# EAGLE schematic Dragino Pan.v1.7 (EAGLE 7.5.0)

## Sheet 1 of 6
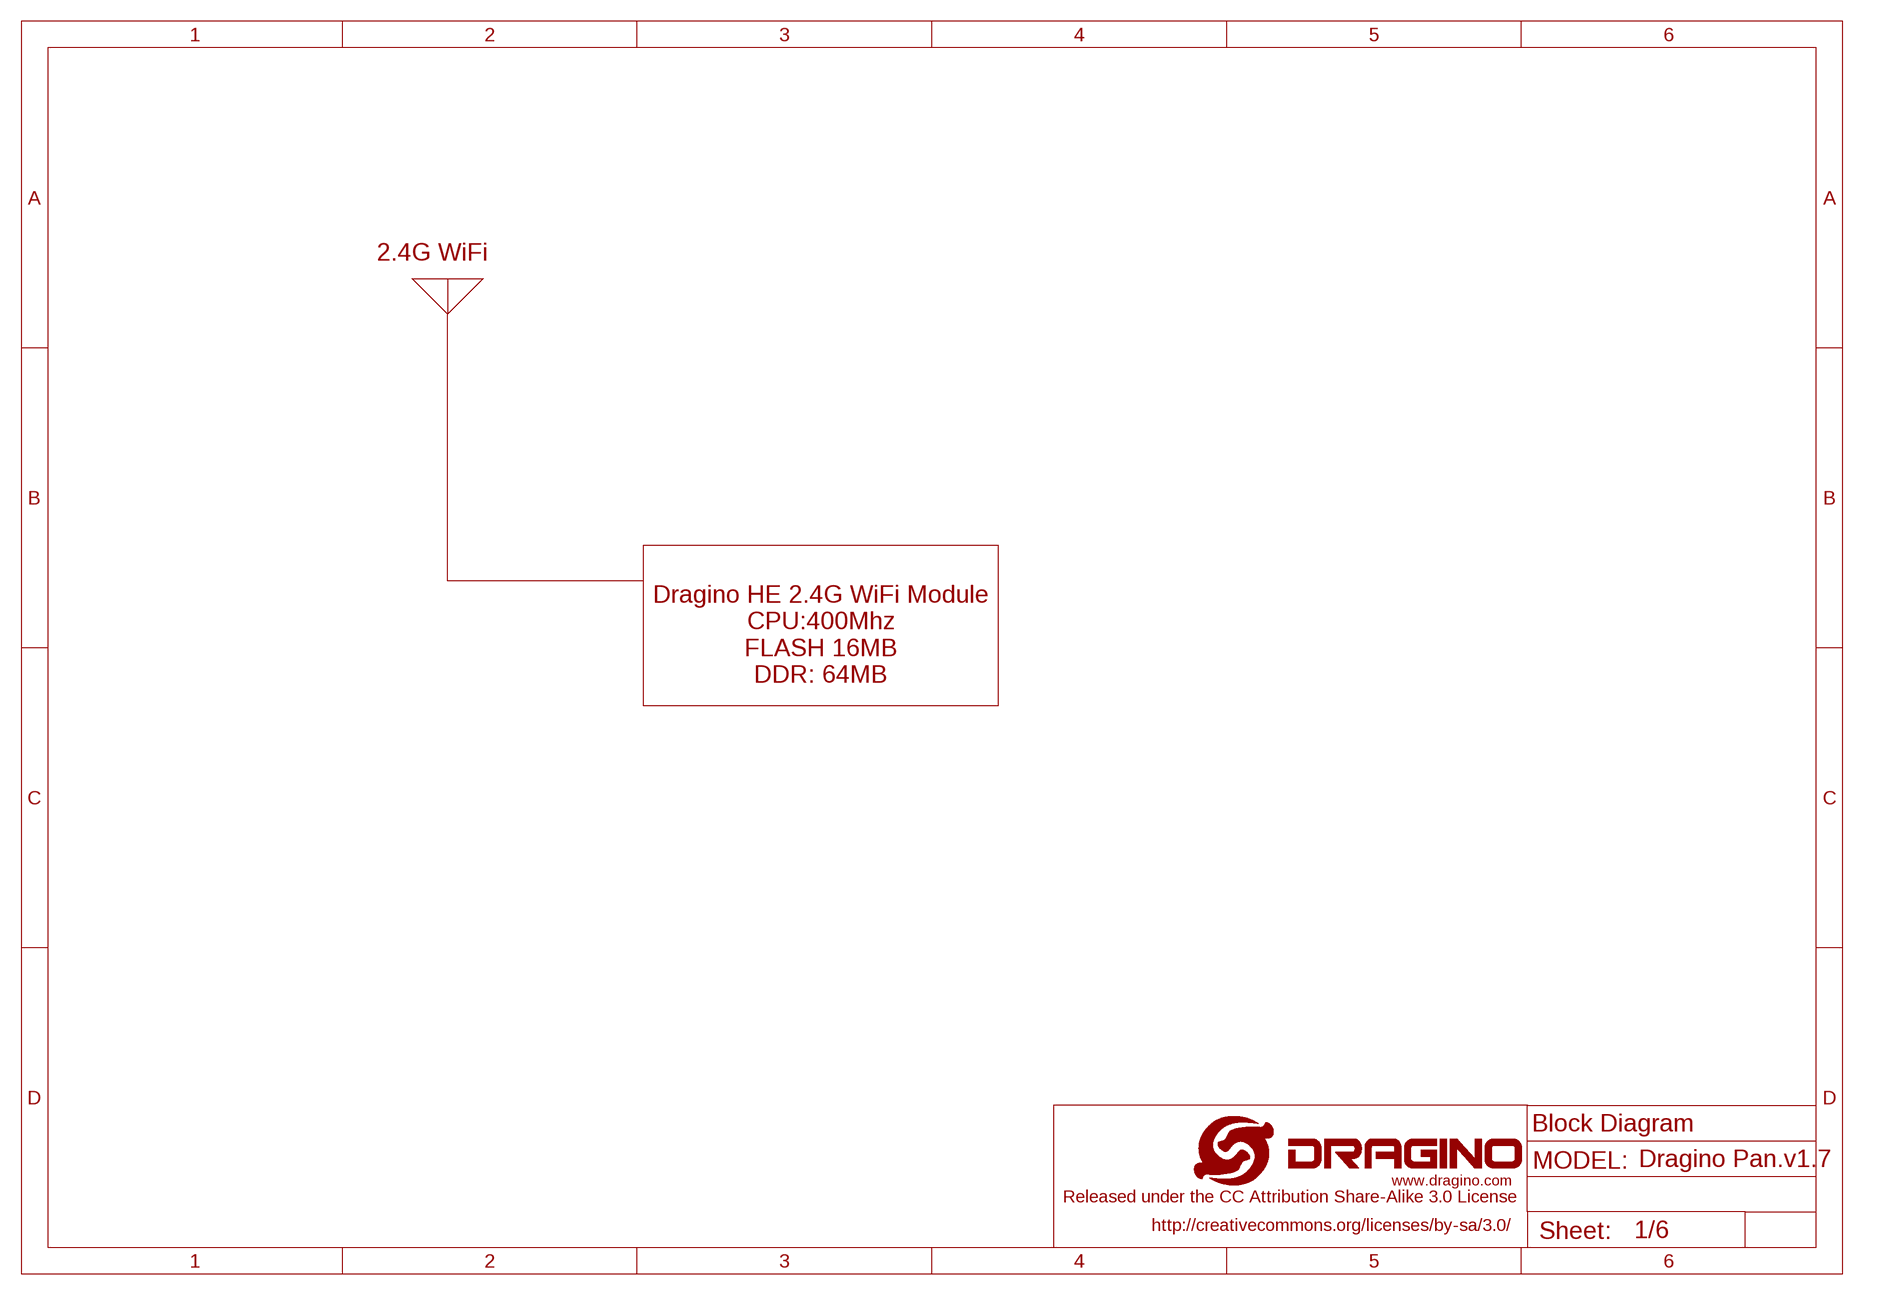
[diagram p0: schematic, sheet 1]

### Notes on the sheet
- 2.4G WiFi
- Dragino HE 2.4G WiFi Module
  CPU:400Mhz
  FLASH 16MB
  DDR: 64MB
- Block Diagram

## Sheet 2 of 6
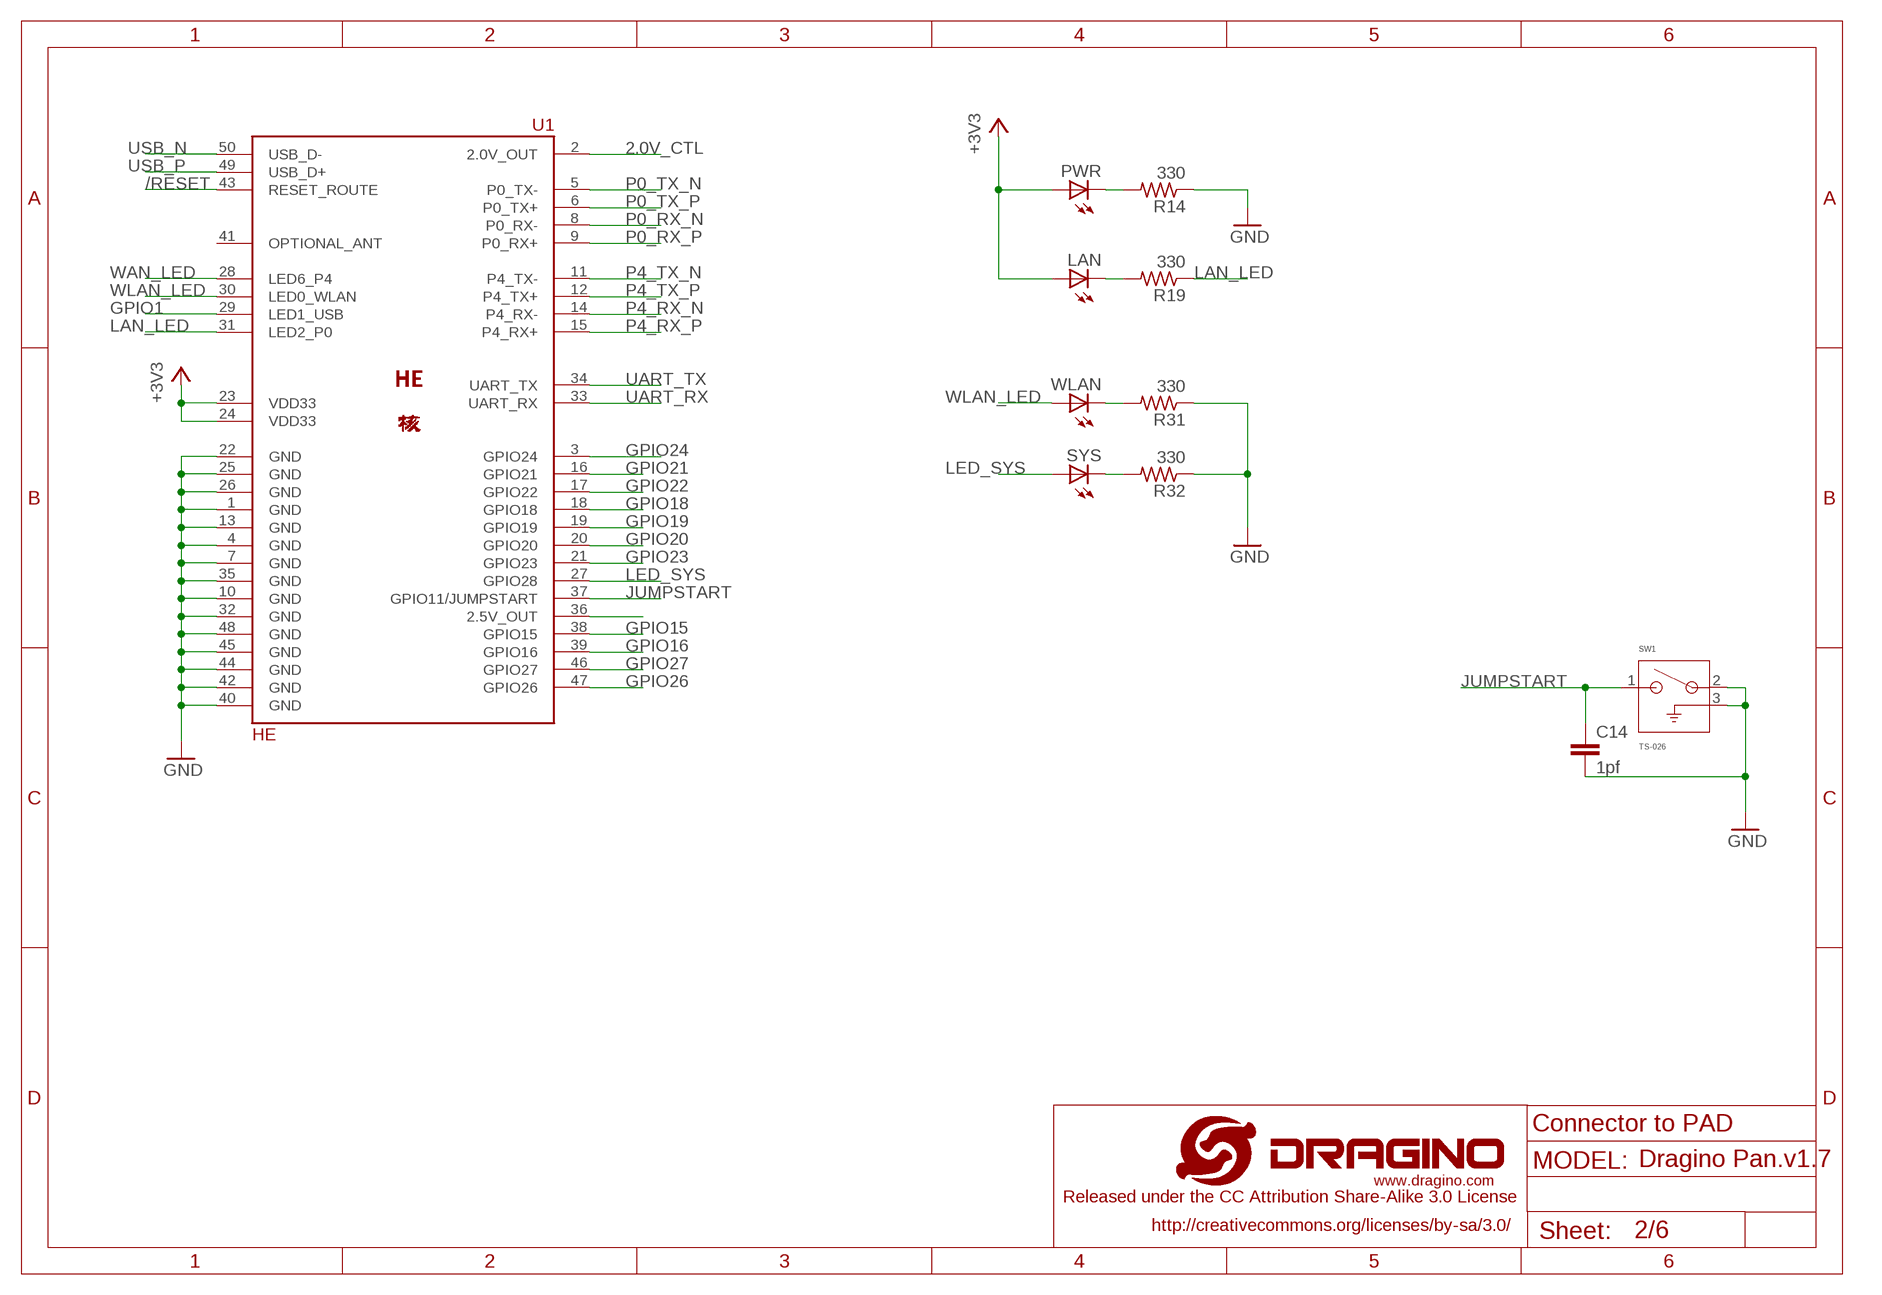
[diagram p1: schematic, sheet 2]

### Parts
C14  1pf  C-EUC0402  [C0402]
LAN  LED3MM  [LED3MM]
PWR  LED3MM  [LED3MM]
R14  330  R-US_R0402  [R0402]
R19  330  R-US_R0402  [R0402]
R31  330  R-US_R0402  [R0402]
R32  330  R-US_R0402  [R0402]
SW1  TS-026  [TS-026]
SYS  LED3MM  [LED3MM]
U1  HE  [HE50]
U$3  LOGO-NEW  [LOGO-SILK-NEW]
WLAN  LED3MM  [LED3MM]

### Nets
2.0V_CTL: U1.2(2.0V_OUT) ; also sheet 4
+3V3: LAN.A PWR.A U1.23(VDD33) U1.24(VDD33) ; also sheet 3,5
/RESET: U1.43(RESET_ROUTE) ; also sheet 5
GND: C14.2 R14.1 R31.1 R32.1 SW1.2 SW1.3 U1.1(GND) U1.4(GND) U1.7(GND) U1.10(GND) U1.13(GND) U1.22(GND) U1.25(GND) U1.26(GND) U1.32(GND) U1.35(GND) U1.40(GND) U1.42(GND) U1.44(GND) U1.45(GND) U1.48(GND) ; also sheet 3,4,5,6
GPIO1: U1.29(LED1_USB) ; also sheet 3
GPIO15: U1.38(GPIO15) ; also sheet 5
GPIO16: U1.39(GPIO16) ; also sheet 5
GPIO18: U1.18(GPIO18) ; also sheet 5
GPIO19: U1.19(GPIO19) ; also sheet 5
GPIO20: U1.20(GPIO20) ; also sheet 5
GPIO21: U1.16(GPIO21) ; also sheet 5
GPIO22: U1.17(GPIO22) ; also sheet 5
GPIO23: U1.21(GPIO23) ; also sheet 5
GPIO24: U1.3(GPIO24) ; also sheet 5
GPIO26: U1.47(GPIO26) ; also sheet 5
GPIO27: U1.46(GPIO27) ; also sheet 5
JUMPSTART: C14.1 SW1.1 U1.37(GPIO11/JUMPSTART)
LAN_LED: R19.1 U1.31(LED2_P0)
LED_SYS: SYS.A U1.27(GPIO28)
N$6: PWR.K(C) R14.2
N$23: LAN.K(C) R19.2
N$31: R31.2 WLAN.K(C)
N$32: R32.2 SYS.K(C)
N$52: U1.36(2.5V_OUT)
P0_RX_N: U1.8(P0_RX-) ; also sheet 4
P0_RX_P: U1.9(P0_RX+) ; also sheet 4
P0_TX_N: U1.5(P0_TX-) ; also sheet 4
P0_TX_P: U1.6(P0_TX+) ; also sheet 4
P4_RX_N: U1.14(P4_RX-) ; also sheet 4
P4_RX_P: U1.15(P4_RX+) ; also sheet 4
P4_TX_N: U1.11(P4_TX-) ; also sheet 4
P4_TX_P: U1.12(P4_TX+) ; also sheet 4
UART_RX: U1.33(UART_RX) ; also sheet 5
UART_TX: U1.34(UART_TX) ; also sheet 5
USB_N: U1.50(USB_D-) ; also sheet 6
USB_P: U1.49(USB_D+) ; also sheet 6
WAN_LED: U1.28(LED6_P4)
WLAN_LED: U1.30(LED0_WLAN) WLAN.A

### Notes on the sheet
- Connector to PAD

## Sheet 3 of 6
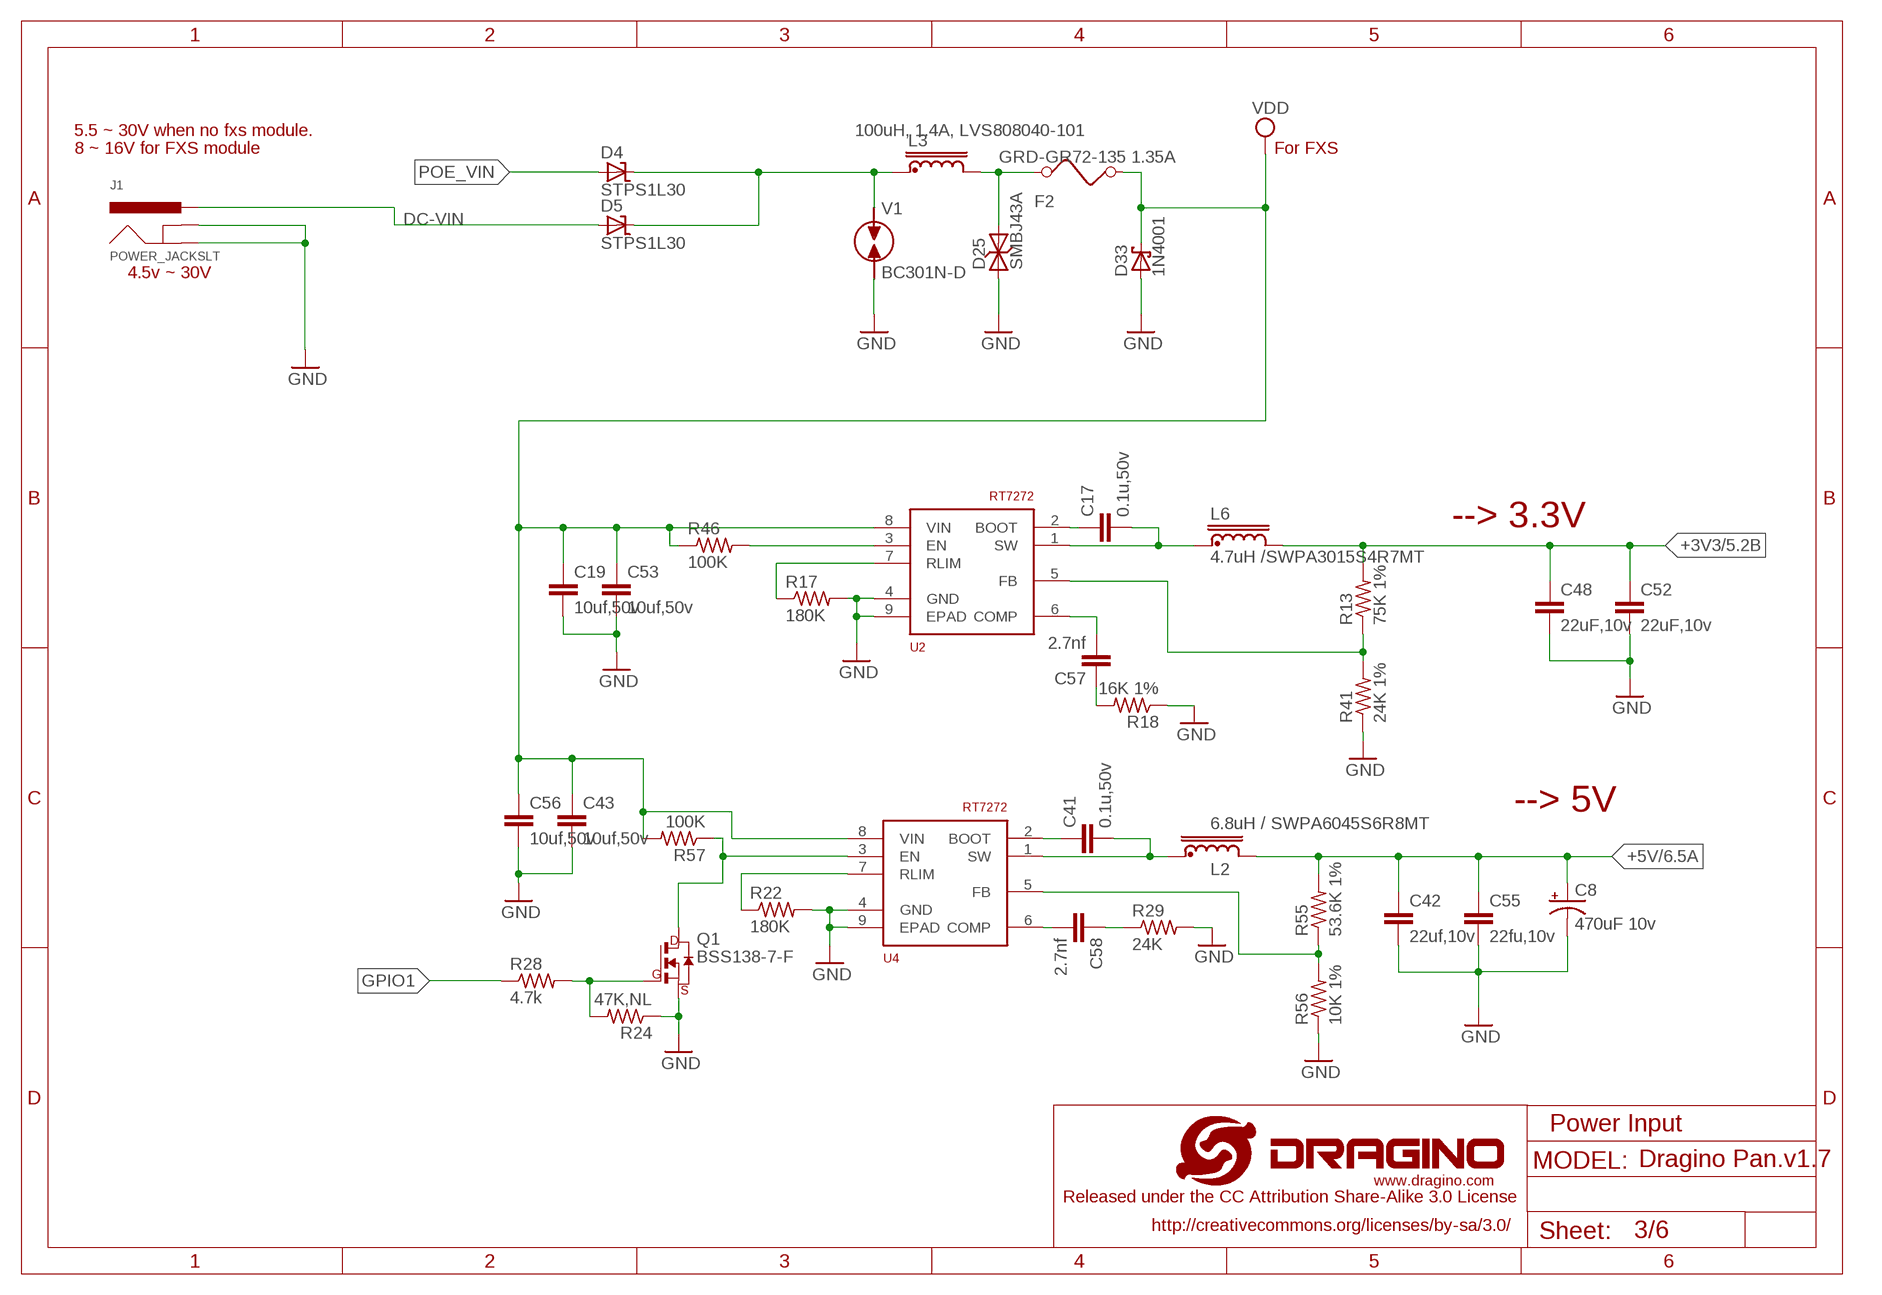
[diagram p2: schematic, sheet 3]

### Parts
C8  470uF 10v  CPOL-US140CLH-0810  [140CLH-0810]
C17  0.1u,50v  C-EUC0402  [C0402]
C19  10uf,50v  C-EUC1206  [C1206]
C41  0.1u,50v  C-EUC0402  [C0402]
C42  22uf,10v  C-EUC1210  [C1210]
C43  10uf,50v  C-EUC1206  [C1206]
C48  22uF,10v  C-EUC1210  [C1210]
C52  22uF,10v  C-EUC1210  [C1210]
C53  10uf,50v  C-EUC1206  [C1206]
C55  22fu,10v  C-EUC1210  [C1210]
C56  10uf,50v  C-EUC1206  [C1206]
C57  2.7nf  C-EUC0402  [C0402]
C58  2.7nf  C-EUC0402  [C0402]
D4  STPS1L30  SCHOTTKYSMBG  [DO214AC]
D5  STPS1L30  SCHOTTKYSMBG  [DO214AC]
D25  SMBJ43A  TVSDIO-214AA  [DO-214AA]
D33  1N4001  SCHOTTKY-DIODEF126Z12  [F126Z12]
F2  GRD-GR72-135 1.35A  FUSEGR72-135  [GR72-135]
J1  POWER_JACKSLT  [POWER_JACK_SLOT]
L2  6.8uH / SWPA6045S6R8MT  INDUCTOR6028S  [SWPA6028S]
L3  100uH, 1.4A, LVS808040-101  INDUCTORLVS808040  [LVS808040]
L6  4.7uH /SWPA3015S4R7MT  INDUCTORSWPA3010S  [SWPA3010S]
Q1  BSS138-7-F  NMOSFET  [SOT-23]
R13  75K 1%  R-US_R0402  [R0402]
R17  180K  R-US_R0402  [R0402]
R18  16K 1%  R-US_R0402  [R0402]
R22  180K  R-US_R0402  [R0402]
R24  47K,NL  R-US_R0402  [R0402]
R28  4.7k  R-US_R0402  [R0402]
R29  24K  R-US_R0402  [R0402]
R41  24K 1%  R-US_R0402  [R0402]
R46  100K  R-US_R0402  [R0402]
R55  53.6K 1%  R-US_R0402  [R0402]
R56  10K 1%  R-US_R0402  [R0402]
R57  100K  R-US_R0402  [R0402]
U2  RT7272  [RT8250-SOP8]
U4  RT7272  [RT8250-SOP8]
V1  BC301N-D  GDT-2PIN  [BC301N-D]

### Nets
+3V3: C48.1 C52.1 L6.P$2 R13.2 ; also sheet 2,5
+5V: C8.+ C42.1 C55.1 L2.P$2 R55.2 ; also sheet 5,6
DC-VIN: D5.A J1.PWR
GND: C8.- C19.2 C42.2 C43.2 C48.2 C52.2 C53.2 C55.2 C56.2 D25.A D33.A J1.GND@1(GNDBREAK) J1.GND@2(GND) Q1.2(S) R17.2 R18.1 R22.2 R24.1 R29.2 R41.1 R56.1 U2.4(GND) U2.9(EPAD) U4.4(GND) U4.9(EPAD) V1.P$1 ; also sheet 2,4,5,6
GPIO1: R28.1 ; also sheet 2
N$2: C17.2 L6.P$1 U2.1(SW)
N$9: C57.1 R18.2
N$13: C57.2 U2.6(COMP)
N$14 [gnd]: R55.1 R56.2 U4.5(FB)
N$15: Q1.1(D) R57.1 U4.3(EN)
N$19: R22.1 U4.7(RLIM)
N$20: Q1.3(G) R24.2 R28.2
N$21: C58.2 U4.6(COMP)
N$25: R46.2 U2.3(EN)
N$26: R17.1 U2.7(RLIM)
N$27: C17.1 U2.2(BOOT)
N$28: C58.1 R29.1
N$34: C41.2 L2.P$1 U4.1(SW)
N$49: R13.1 R41.2 U2.5(FB)
N$53: D25.C F2.P$1 L3.P$2
N$55: C41.1 U4.2(BOOT)
POE_VIN: D4.A ; also sheet 4
VDD: C19.1 C43.1 C53.1 C56.1 D33.C F2.P$2 R46.1 R57.2 U2.8(VIN) U4.8(VIN) ; also sheet 5
VIN1: D4.C D5.C L3.P$1 V1.P$2

### Notes on the sheet
- 5.5 ~ 30V when no fxs module.
- 8 ~ 16V for FXS module | For FXS
- 4.5v ~ 30V
- --> 3.3V
- --> 5V
- Power Input

## Sheet 4 of 6
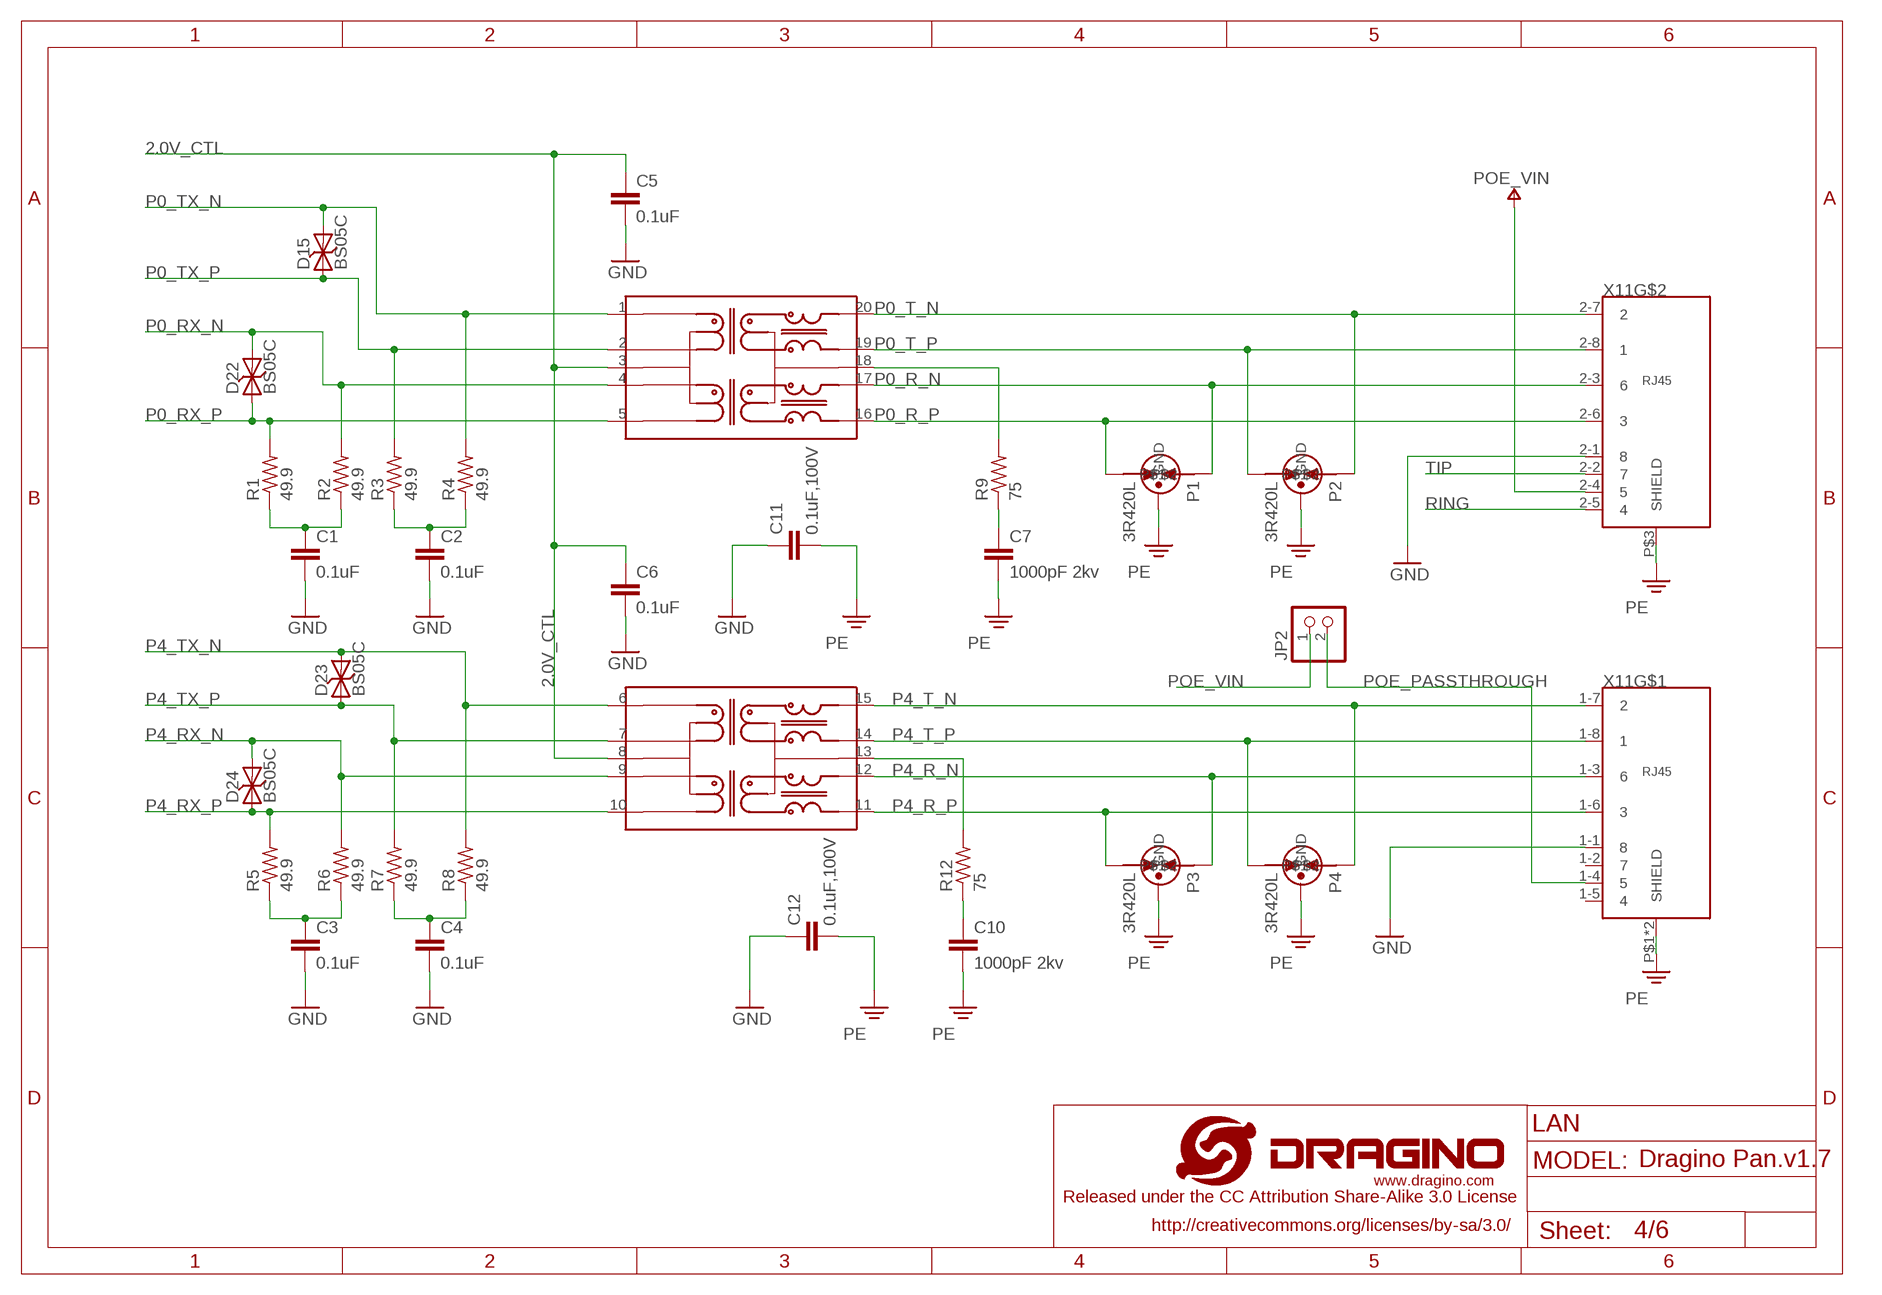
[diagram p3: schematic, sheet 4]

### Parts
C1  0.1uF  C-EUC0402  [C0402]
C2  0.1uF  C-EUC0402  [C0402]
C3  0.1uF  C-EUC0402  [C0402]
C4  0.1uF  C-EUC0402  [C0402]
C5  0.1uF  C-EUC0402  [C0402]
C6  0.1uF  C-EUC0402  [C0402]
C7  1000pF 2kv  C-EUC1206  [C1206]
C10  1000pF 2kv  C-EUC1206  [C1206]
C11  0.1uF,100V  C-EUC0805  [C0805]
C12  0.1uF,100V  C-EUC0805  [C0805]
D15  BS05C  TVSSOD323  [SOD−323]
D22  BS05C  TVSSOD323  [SOD−323]
D23  BS05C  TVSSOD323  [SOD−323]
D24  BS05C  TVSSOD323  [SOD−323]
JP2  PINHD-1X2  [1X02]
P1  3R420L  GDT  [GDT-LT-B3D090L]
P2  3R420L  GDT  [GDT-LT-B3D090L]
P3  3R420L  GDT  [GDT-LT-B3D090L]
P4  3R420L  GDT  [GDT-LT-B3D090L]
R1  49.9  R-US_R0402  [R0402]
R2  49.9  R-US_R0402  [R0402]
R3  49.9  R-US_R0402  [R0402]
R4  49.9  R-US_R0402  [R0402]
R5  49.9  R-US_R0402  [R0402]
R6  49.9  R-US_R0402  [R0402]
R7  49.9  R-US_R0402  [R0402]
R8  49.9  R-US_R0402  [R0402]
R9  75  R-US_R0402  [R0402]
R12  75  R-US_R0402  [R0402]
T1  RJ45_TRANSFORMER_HST2038DR  [RIONET_H2038]
X11  EHERNET-1X2-PLASTIC  [EHERNET-1X2-PLASTIC1]

### Nets
2.0V_CTL: C5.1 C6.1 T1.3(CT1) T1.8(CT1) ; also sheet 2
GND: C1.2 C2.2 C3.2 C4.2 C5.2 C6.2 C11.1 C12.1 X11.1-1 X11.2-1 ; also sheet 2,3,5,6
N$1: C1.1 R1.1 R2.1
N$3: C2.1 R3.1 R4.1
N$4: C3.1 R5.1 R6.1
N$5: C4.1 R7.1 R8.1
N$10: R9.2 T1.18(CT2)
N$12: C7.1 R9.1
N$17: R12.2 T1.13(CT2)
N$18: C10.1 R12.1
P0_R_N: P1.3 T1.17(RX+) X11.2-3
P0_R_P: P1.1 T1.16(RX-) X11.2-6
P0_RX_N: D22.P$2 R2.2 T1.4(RD+) ; also sheet 2
P0_RX_P: D22.P$1 R1.2 T1.5(RD-) ; also sheet 2
P0_T_N: P2.3 T1.20(TX+) X11.2-7
P0_T_P: P2.1 T1.19(TX-) X11.2-8
P0_TX_N: D15.P$2 R4.2 T1.1(TD+) ; also sheet 2
P0_TX_P: D15.P$1 R3.2 T1.2(TD-) ; also sheet 2
P4_R_N: P3.3 T1.12(RX+) X11.1-3
P4_R_P: P3.1 T1.11(RX-) X11.1-6
P4_RX_N: D24.P$2 R6.2 T1.9(RD+) ; also sheet 2
P4_RX_P: D24.P$1 R5.2 T1.10(RD-) ; also sheet 2
P4_T_N: P4.3 T1.15(TX+) X11.1-7
P4_T_P: P4.1 T1.14(TX-) X11.1-8
P4_TX_N: D23.P$2 R8.2 T1.6(TD+) ; also sheet 2
P4_TX_P: D23.P$1 R7.2 T1.7(TD-) ; also sheet 2
PE: C7.2 C10.2 C11.2 C12.2 P1.2(GND) P2.2(GND) P3.2(GND) P4.2(GND) X11.P$1(SHIELD) X11.P$2(SHIELD) X11.P$3(SHIELD)
POE_PASSTHROUGH: JP2.2 X11.1-4
POE_VIN: JP2.1 X11.2-4 ; also sheet 3
RING: X11.2-5 ; also sheet 5
TIP: X11.2-2 ; also sheet 5
Unconnected: X11.1-2 X11.1-5

### Notes on the sheet
- LAN

## Sheet 5 of 6
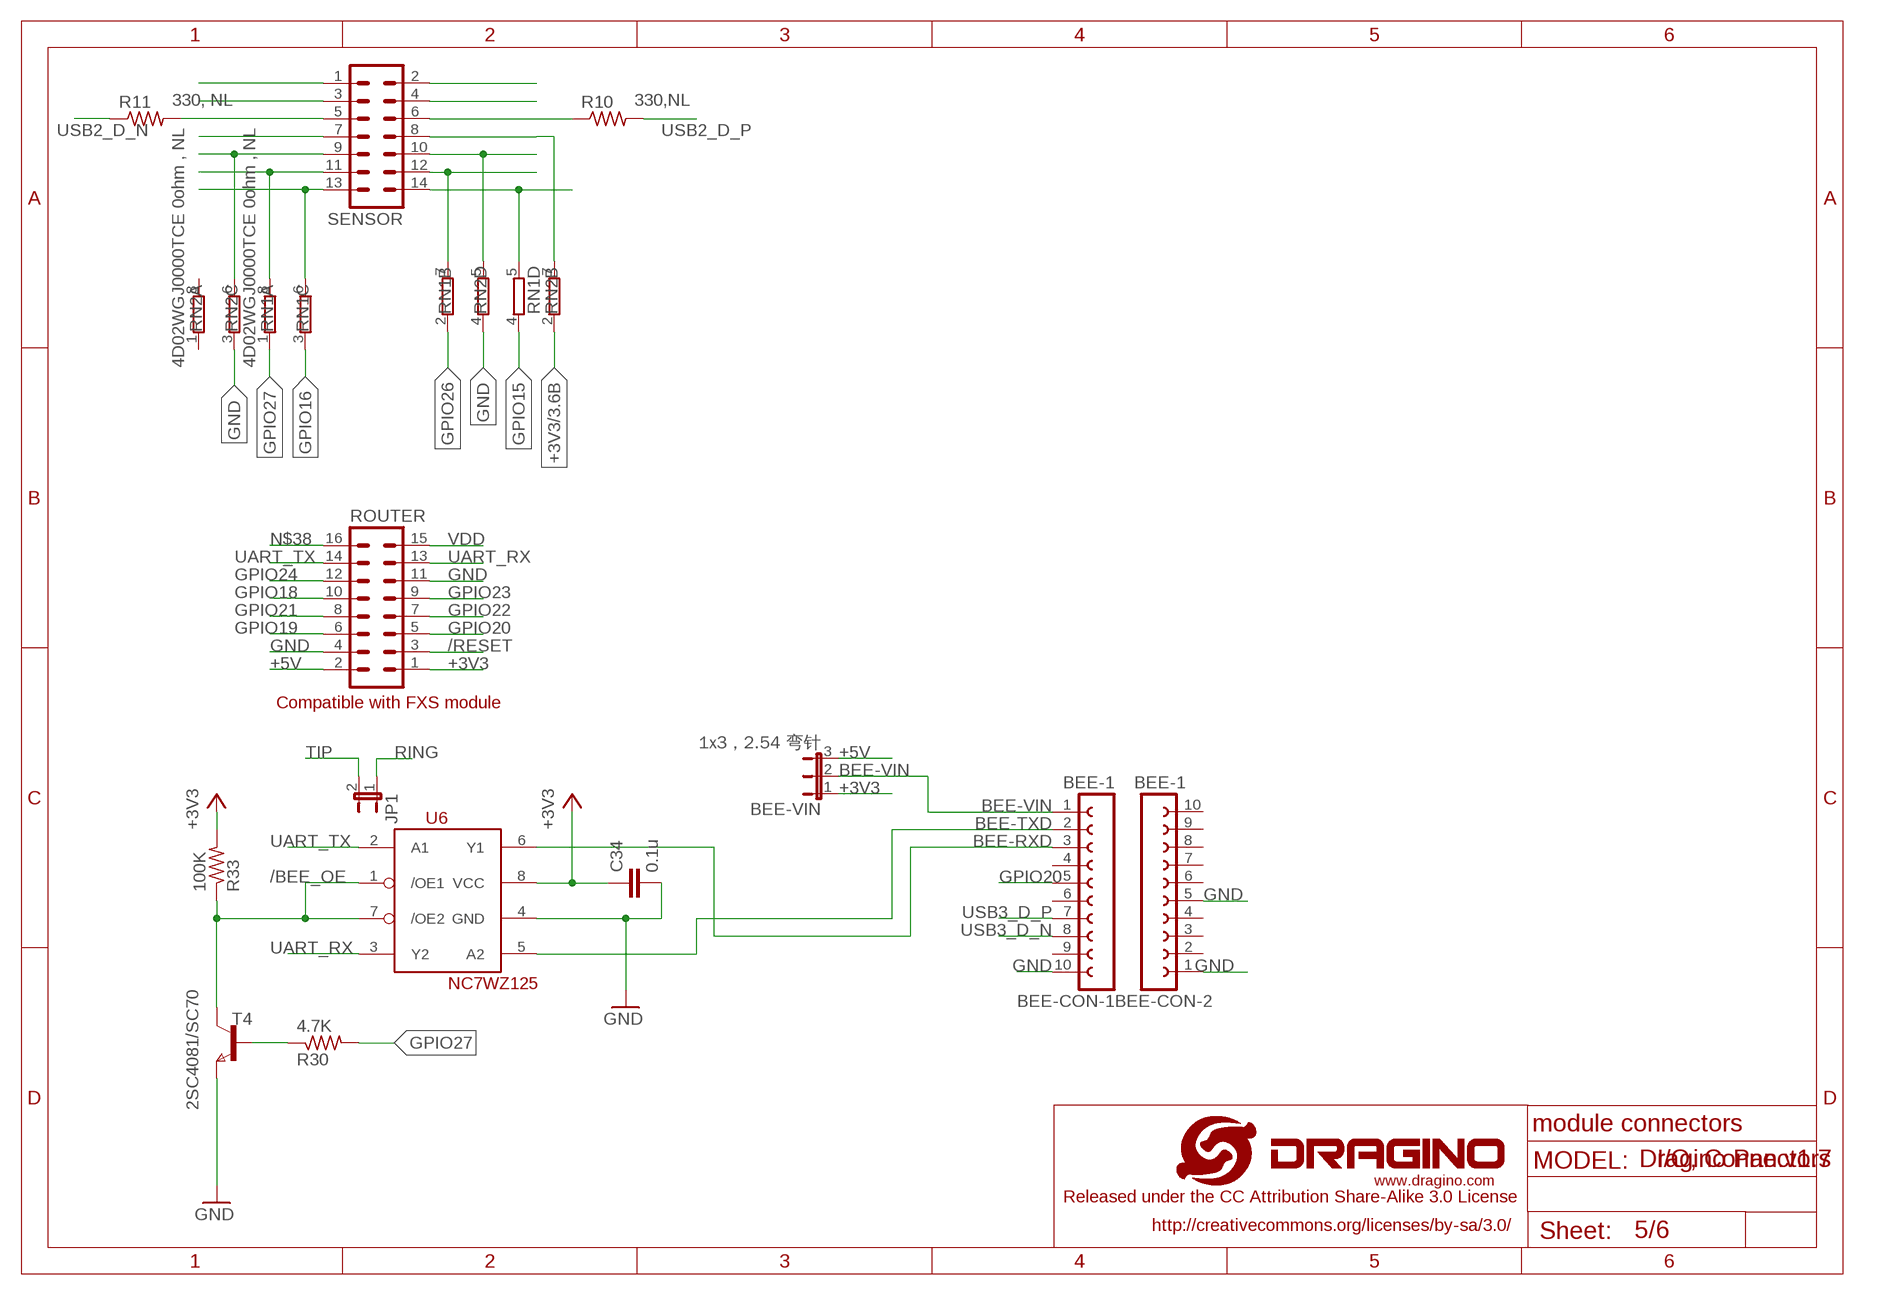
[diagram p4: schematic, sheet 5]

### Parts
BEE-CON-1  BEE-1  CON-10P10P-2.0  [10P-2.0MM]
BEE-CON-2  BEE-1  CON-10P10P-2.0  [10P-2.0MM]
BEE-VIN  1x3 , 2.54 弯针  JP2E  [JP2]
C34  0.1u  C-EUC0402  [C0402]
JP1  JP1E  [JP1]
R10  330,NL  R-US_R0402  [R0402]
R11  330, NL  R-US_R0402  [R0402]
R30  4.7K  R-US_R0402  [R0402]
R33  100K  R-US_R0402  [R0402]
RN1  4D02WGJ0000TCE 0ohm , NL  4R-N0603-ARC  [0603-ARC]
RN2  4D02WGJ0000TCE 0ohm , NL  4R-N0603-ARC  [0603-ARC]
ROUTER  MA08-2  [MA08-2]
SENSOR  MA07-2  [MA07-2]
T4  2SC4081/SC70  NPNSOT323  [SOT323]
U6  NC7WZ125  [US8]

### Nets
+3V3: BEE-VIN.1 C34.1 R33.2 RN2.2 ROUTER.1 U6.8(VCC) ; also sheet 2,3
+5V: BEE-VIN.3 ROUTER.2 ; also sheet 3,6
/BEE_OE: R33.1 T4.1(C) U6.1(/OE1) U6.7(/OE2)
/RESET: ROUTER.3 ; also sheet 2
BEE-RXD: BEE-CON-1.3 U6.6(Y1)
BEE-TXD: BEE-CON-1.2 U6.5(A2)
BEE-VIN: BEE-CON-1.1 BEE-VIN.2
GND: BEE-CON-1.10 BEE-CON-2.1 BEE-CON-2.5 C34.2 RN2.3 RN2.4 ROUTER.4 ROUTER.11 T4.3(E) U6.4(GND) ; also sheet 2,3,4,6
GPIO15: RN1.4 ; also sheet 2
GPIO16: RN1.3 ; also sheet 2
GPIO18: ROUTER.10 ; also sheet 2
GPIO19: ROUTER.6 ; also sheet 2
GPIO20: BEE-CON-1.5 ROUTER.5 ; also sheet 2
GPIO21: ROUTER.8 ; also sheet 2
GPIO22: ROUTER.7 ; also sheet 2
GPIO23: ROUTER.9 ; also sheet 2
GPIO24: ROUTER.12 ; also sheet 2
GPIO26: RN1.2 ; also sheet 2
GPIO27: R30.2 RN1.1 ; also sheet 2
N$11: SENSOR.2
N$33: SENSOR.1
N$35: RN1.5 SENSOR.14
N$36: R30.1 T4.2(B)
N$38: ROUTER.16
N$43: SENSOR.3
N$45: SENSOR.7
N$46: RN2.6 SENSOR.9
N$47: RN1.8 SENSOR.11
N$48: RN1.6 SENSOR.13
N$50: SENSOR.4
N$54: RN2.7 SENSOR.8
N$56: RN2.5 SENSOR.10
N$57: RN1.7 SENSOR.12
RING: JP1.1 ; also sheet 4
TIP: JP1.2 ; also sheet 4
UART_RX: ROUTER.13 U6.3(Y2) ; also sheet 2
UART_TX: ROUTER.14 U6.2(A1) ; also sheet 2
USB2_D1_N: R11.2 SENSOR.5
USB2_D1_P: R10.1 SENSOR.6
USB2_D_N: R11.1 ; also sheet 6
USB2_D_P: R10.2 ; also sheet 6
USB3_D_N [usbtrace]: BEE-CON-1.8 ; also sheet 6
USB3_D_P [usbtrace]: BEE-CON-1.7 ; also sheet 6
VDD: ROUTER.15 ; also sheet 3
Unconnected: BEE-CON-1.4 BEE-CON-1.6 BEE-CON-1.9 BEE-CON-2.2 BEE-CON-2.3 BEE-CON-2.4 BEE-CON-2.6 BEE-CON-2.7 BEE-CON-2.8 BEE-CON-2.9 BEE-CON-2.10 RN2.1 RN2.8

### Notes on the sheet
- Compatible with FXS module
- module connectors
- I/O, Connectors

## Sheet 6 of 6
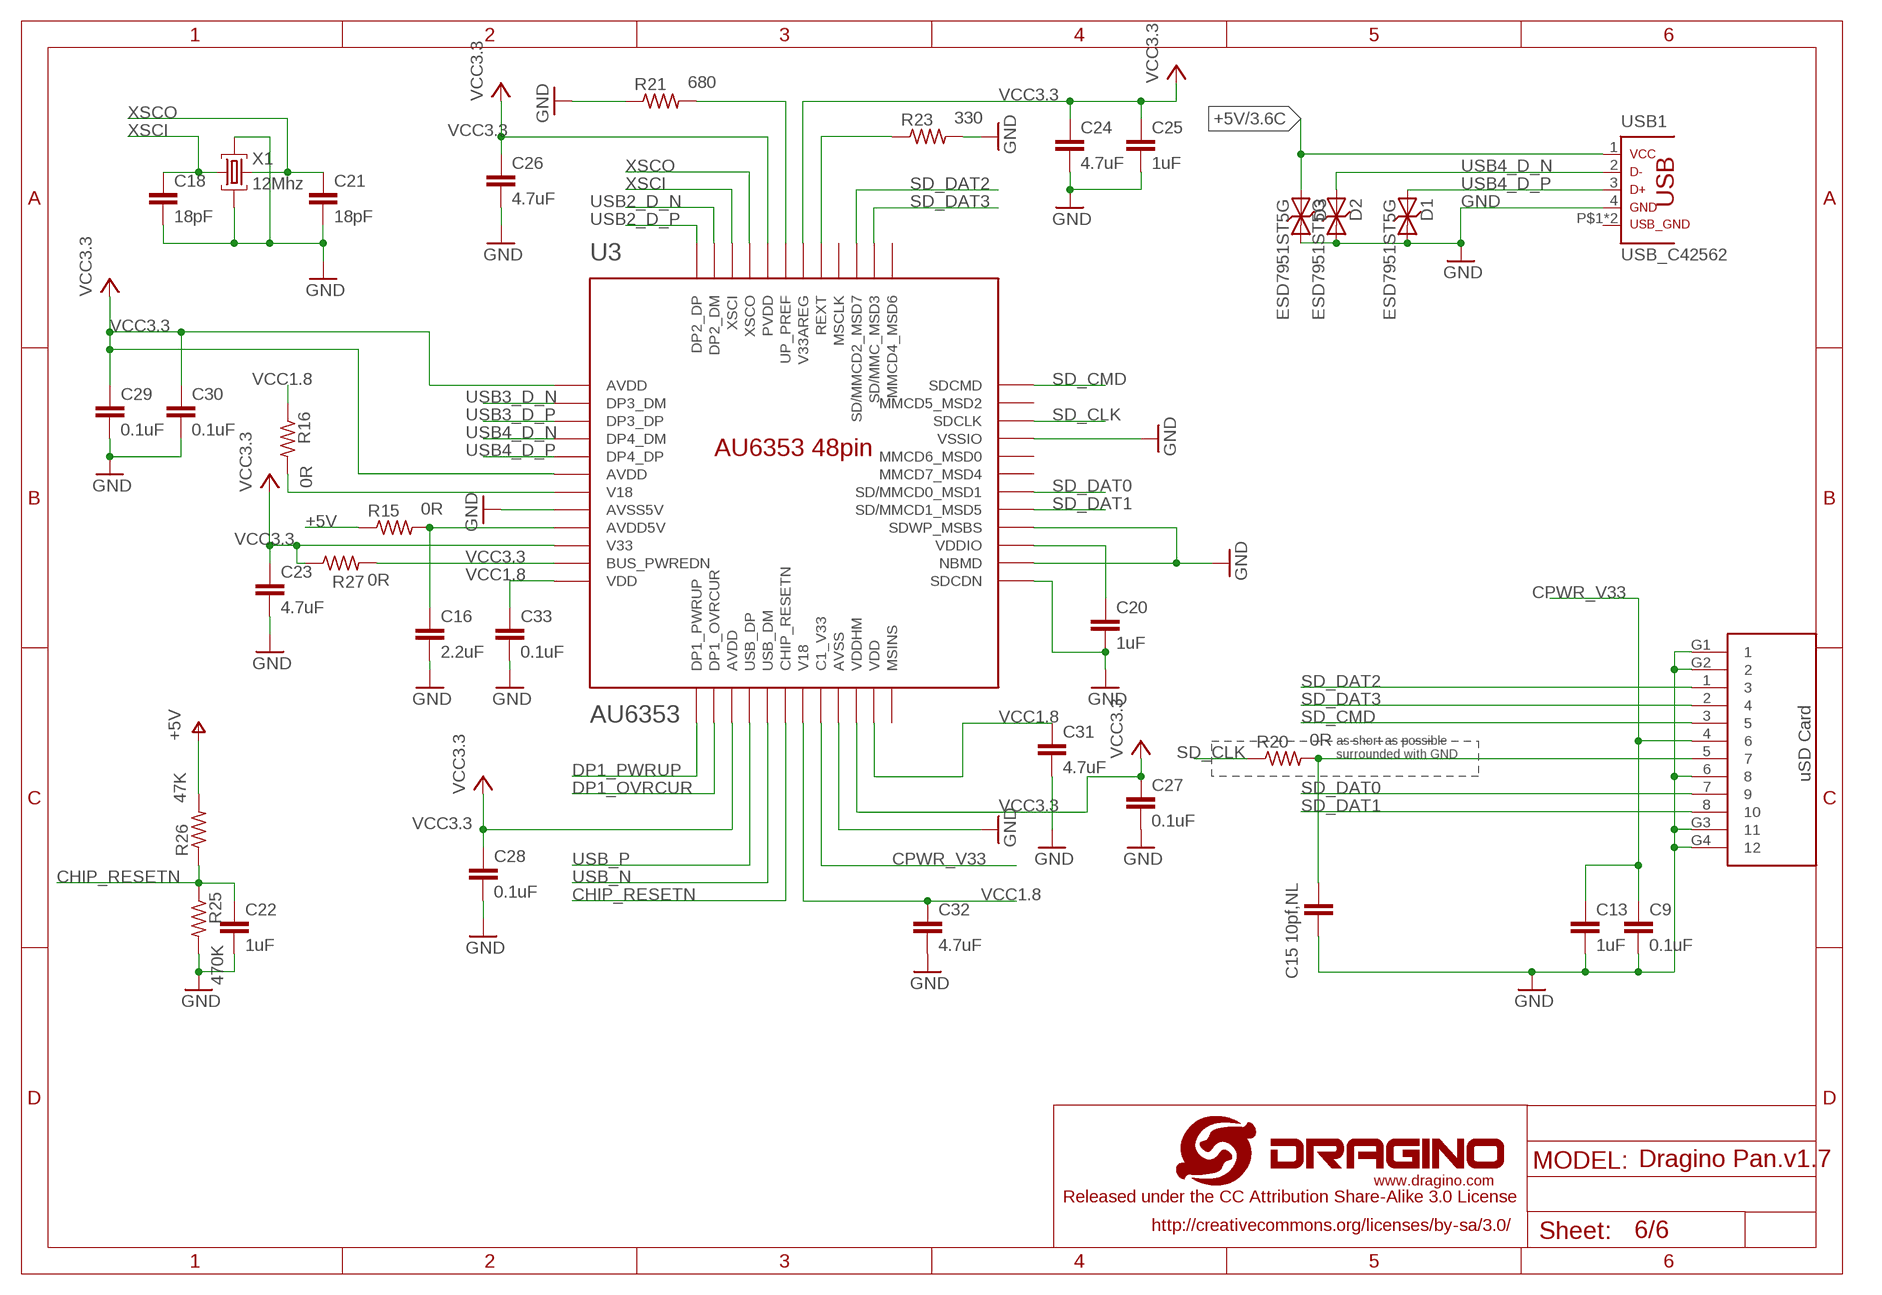
[diagram p5: schematic, sheet 6]

### Parts
C9  0.1uF  C-EUC0402  [C0402]
C13  1uF  C-EUC0402  [C0402]
C15  10pf,NL  C-EUC0402  [C0402]
C16  2.2uF  C-EUC0402  [C0402]
C18  18pF  C-EUC0402  [C0402]
C20  1uF  C-EUC0402  [C0402]
C21  18pF  C-EUC0402  [C0402]
C22  1uF  C-EUC0402  [C0402]
C23  4.7uF  C-EUC0402  [C0402]
C24  4.7uF  C-EUC0402  [C0402]
C25  1uF  C-EUC0402  [C0402]
C26  4.7uF  C-EUC0402  [C0402]
C27  0.1uF  C-EUC0402  [C0402]
C28  0.1uF  C-EUC0402  [C0402]
C29  0.1uF  C-EUC0402  [C0402]
C30  0.1uF  C-EUC0402  [C0402]
C31  4.7uF  C-EUC0402  [C0402]
C32  4.7uF  C-EUC0402  [C0402]
C33  0.1uF  C-EUC0402  [C0402]
D1  ESD7951ST5G  TVSSOD−923  [SOD−923]
D2  ESD7951ST5G  TVSSOD−923  [SOD−923]
D3  ESD7951ST5G  TVSSOD−923  [SOD−923]
R15  0R  R-US_R0402  [R0402]
R16  0R  R-US_R0402  [R0402]
R20  0R  R-US_R0402  [R0402]
R21  680  R-US_R0402  [R0402]
R23  330  R-US_R0402  [R0402]
R25  470K  R-US_R0402  [R0402]
R26  47K  R-US_R0402  [R0402]
R27  0R  R-US_R0402  [R0402]
U3  AU6353  AU6353-48PIN  [AU6350_LQFP-48]
U$14  RIONET_SDCARD  [RIONET_472192001_SD]
USB1  USB_C42562  [USB_C42562]
X1  12Mhz  SMARTPRJ_CRYSTAL-3.2-2.5  [SMARTPRJ_CRYSTAL-3.2-2.5]

### Nets
+5V: D3.P$1 R15.1 R26.2 USB1.1 ; also sheet 3,5
CHIP_RESETN: C22.1 R25.1 R26.1 U3.18(CHIP_RESETN)
CPWR_V33: C9.1 C13.1 U3.20(C1_V33) U$14.4
DP1_OVRCUR: U3.14(DP1_OVRCUR)
DP1_PWRUP: U3.13(DP1_PWRUP)
GND: C9.2 C13.2 C15.2 C16.2 C18.2 C20.2 C21.2 C22.2 C23.2 C24.2 C25.2 C26.2 C27.2 C28.2 C29.2 C30.2 C31.2 C32.2 C33.2 D1.P$2 D2.P$2 D3.P$2 R21.1 R23.2 R25.2 U3.8(AVSS5V) U3.21(AVSS) U3.25(SDCDN) U3.26(NBMD) U3.28(SDWP_MSBS) U3.33(VSSIO) U$14.6 U$14.G1 U$14.G2 U$14.G3 U$14.G4 USB1.4 X1.2(GND) X1.4(GND) ; also sheet 2,3,4,5
N$7: R23.1 U3.41(REXT)
N$8: C20.1 U3.27(VDDIO)
N$16: R21.2 U3.43(UP_PREF)
N$22: C15.1 R20.2 U$14.5
N$24: R27.2 U3.11(BUS_PWREDN)
N$29: C16.1 R15.2 U3.9(AVDD5V)
N$30: R16.2 U3.7(V18)
SD_CLK: R20.1 U3.34(SDCLK)
SD_CMD: U3.36(SDCMD) U$14.3
SD_DAT0: U3.30(SD/MMCD0_MSD1) U$14.7
SD_DAT1: U3.29(SD/MMCD1_MSD5) U$14.8
SD_DAT2: U3.39(SD/MMCD2_MSD7) U$14.1
SD_DAT3: U3.38(SD/MMC_MSD3) U$14.2
USB2_D_N: U3.47(DP2_DM) ; also sheet 5
USB2_D_P: U3.48(DP2_DP) ; also sheet 5
USB3_D_N [usbtrace]: U3.2(DP3_DM) ; also sheet 5
USB3_D_P [usbtrace]: U3.3(DP3_DP) ; also sheet 5
USB4_D_N [usbtrace-4layer]: D2.P$1 U3.4(DP4_DM) USB1.2
USB4_D_P [usbtrace-4layer]: D1.P$1 U3.5(DP4_DP) USB1.3
USB_N: U3.17(USB_DM) ; also sheet 2
USB_P: U3.16(USB_DP) ; also sheet 2
VCC1.8: C31.1 C32.1 C33.1 R16.1 U3.12(VDD) U3.19(V18) U3.23(VDD)
VCC3.3: C23.1 C24.1 C25.1 C26.1 C27.1 C28.1 C29.1 C30.1 R27.1 U3.1(AVDD) U3.6(AVDD) U3.10(V33) U3.15(AVDD) U3.22(VDDHM) U3.42(V33AREG) U3.44(PVDD)
XSCI: C18.1 U3.46(XSCI) X1.1(C1)
XSCO: C21.1 U3.45(XSCO) X1.3(C2)
Unconnected: U3.24(MSINS) U3.31(MMCD7_MSD4) U3.32(MMCD6_MSD0) U3.35(MMCD5_MSD2) U3.37(MMCD4_MSD6) U3.40(MSCLK) USB1.P$1 USB1.P$2

### Notes on the sheet
- as short as possible
  surrounded with GND

## Power pins joined to a net without a drawn wire
OPTIONAL_ANT: U1.41(OPTIONAL_ANT)

## Library data of the parts
BEE-CON-1 BEE-CON-2 = dragino-passive:CON-10P: FEMALE HEADER
BEE-VIN = dragino:JP2E: JUMPER
C1-C6 C9 C13-C18 C20-C33 C41 C57 C58 = dragino:C-EU: CAPACITOR, European symbol
C7 C10-C12 C19 C34 C42 C43 C48 C52 C53 C55 C56 = dragino-passive:C-EU: CAPACITOR, European symbol
C8 = dragino:CPOL-US: POLARIZED CAPACITOR, American symbol
D1-D3 D15 D22-D25 = dragino:TVS: DIODE
D4 D5 = dragino:SCHOTTKY: Suppressor diode
D33 = diode:SCHOTTKY-DIODE: Schottky Diode
F2 = dragino:FUSE: FUSE 5 x 20 mm
J1 = dragino:POWER_JACK: Power Jack This is the standard 5.5mm barrel jack for power. The PTH is the most common, proven, reliable, footprint. All others are experimental. The Slot footprint only works if the mill layer is transmitted to the PCB fab house so be warned. Spark Fun Electronics SKU : PRT-00119. Mating wall wart : TOL-00298 (and others)
JP1 = dragino:JP1E: JUMPER
JP2 = pinhead:PINHD-1X2: PIN HEADER
L2 = dragino-passive:INDUCTOR: CHOKE U15
L3 L6 = dragino:INDUCTOR: CHOKE U15
LAN PWR SYS WLAN = led:LED: LED OSRAM: - CHIPLED LG R971, LG N971, LY N971, LG Q971, LY Q971, LO R971, LY R971 LH N974, LH R974 LS Q976, LO Q976, LY Q976 LO Q996 - Hyper CHIPLED LW Q18S LB Q993, LB Q99A, LB R99A - SideLED LS A670, LO A670, LY A670, LG A670, LP A670 LB A673, LV A673, LT A673, LW A673 LH A674 LY A675 LS A676, LA A676, LO A676, LY A676, LW A676 LS A679, LY A679, LG A679 - Hyper Micro SIDELED® LS Y876, LA Y876, LO Y876, LY Y876 LT Y87S - SmartLED LW L88C, LW L88S LB L89C, LB L89S, LG L890 LS L89K, LO L89K, LY L89K LS L896, LA L896, LO L896, LY L896 - TOPLED LS T670, LO T670, LY T670, LG T670, LP T670 LSG T670, LSP T670, LSY T670, LOP T670, LYG T670 LG T671, LOG T671, LSG T671 LB T673, LV T673, LT T673, LW T673 LH T674 LS T676, LA T676, LO T676, LY T676, LB T676, LH T676, LSB T676, LW T676 LB T67C, LV T67C, LT T67C, LS T67K, LO T67K, LY T67K, LW E67C LS E67B, LA E67B, LO E67B, LY E67B, LB E67C, LV E67C, LT E67C LW T67C LS T679, LY T679, LG T679 LS T770, LO T770, LY T770, LG T770, LP T770 LB T773, LV T773, LT T773, LW T773 LH T774 LS E675, LA E675, LY E675, LS T675 LS T776, LA T776, LO T776, LY T776, LB T776 LHGB T686 LT T68C, LB T68C - Hyper Mini TOPLED® LB M676 - Mini TOPLED Santana® LG M470 LS M47K, LO M47K, LY M47K Source: http://www.osram.convergy.de LUXEON: - LUMILED® LXK2-PW12-R00, LXK2-PW12-S00, LXK2-PW14-U00, LXK2-PW14-V00 LXK2-PM12-R00, LXK2-PM12-S00, LXK2-PM14-U00 LXK2-PE12-Q00, LXK2-PE12-R00, LXK2-PE12-S00, LXK2-PE14-T00, LXK2-PE14-U00 LXK2-PB12-K00, LXK2-PB12-L00, LXK2-PB12-M00, LXK2-PB14-N00, LXK2-PB14-P00, LXK2-PB14-Q00 LXK2-PR12-L00, LXK2-PR12-M00, LXK2-PR14-Q00, LXK2-PR14-R00 LXK2-PD12-Q00, LXK2-PD12-R00, LXK2-PD12-S00 LXK2-PH12-R00, LXK2-PH12-S00 LXK2-PL12-P00, LXK2-PL12-Q00, LXK2-PL12-R00 Source: www.luxeon.com KINGBRIGHT: KA-3528ASYC Source: www.kingbright.com
P1-P4 = dragino:GDT
Q1 = dragino:NMOSFET: MOS FET; OC_FARNELL: unknown; OC_NEWARK: unknown
R1-R33 R41 R46 R55-R57 = dragino:R-US_: RESISTOR, American symbol
RN1 RN2 = resistor-dil:4R-N: Array Chip Resistor Source: RS Component / Phycomp; OC_FARNELL: unknown; OC_NEWARK: unknown
ROUTER = dragino:MA08-2: PIN HEADER; OC_FARNELL: unknown; OC_NEWARK: unknown
SENSOR = dragino:MA07-2: PIN HEADER; OC_FARNELL: unknown; OC_NEWARK: unknown
SW1 = _RoweTel:TS-026
T1 = dragino:RJ45_TRANSFORMER_HST2038DR
T4 = zetex:NPNSOT323: NPN TRANSISTOR; MPN: DSS4160U-7; OC_FARNELL: 1710696; OC_NEWARK: 25R4558
U1 = dragino:HE
U2 U4 = dragino:RT7272
U3 = dragino:AU6353-48PIN
U6 = dragino:NC7WZ125: 3 state buffer: http://www.fairchildsemi.com/ds/NC/NC7WZ125.pdf
U$3 = dragino:LOGO-NEW
U$14 = dragino:RIONET_SDCARD
USB1 = dragino-passive:USB_C42562
V1 = dragino:GDT-2PIN
X1 = rionita7:SMARTPRJ_CRYSTAL-3.2-2.5
X11 = dragino-passive:EHERNET-1X2-PLASTIC

## Net classes
0 default: width 0.203 mm, clearance 0.254 mm
2 gnd: width 0.305 mm, drill 0.33 mm, clearance 0.254 mm
3 usbvcc: width 0.254 mm, drill 0.61 mm, clearance 0.254 mm
5 usbtrace: width 0.254 mm, clearance 0.152 mm
6 usbtrace-4layer: width 0.191 mm, clearance 0.203 mm